# EAGLE board Resistor_Resistor (EAGLE 8.3.0), part 10 of 32
## Placement (x,y rotation side) (continued)
R11747  10K  [0201]  96.06,90.27 0 top
R11748  10K  [0201]  96.06,90.88 0 top
R11749  10K  [0201]  96.06,91.49 0 top
R11750  10K  [0201]  96.06,92.1 0 top
R11751  10K  [0201]  96.06,92.71 0 top
R11752  10K  [0201]  96.06,93.32 0 top
R11753  10K  [0201]  96.06,93.93 0 top
R11754  10K  [0201]  96.06,94.54 0 top
R11755  10K  [0201]  96.06,95.15 0 top
R11756  10K  [0201]  96.06,95.76 0 top
R11757  10K  [0201]  96.06,96.37 0 top
R11758  10K  [0201]  96.06,96.98 0 top
R11759  10K  [0201]  96.06,97.59 0 top
R11760  10K  [0201]  96.06,98.2 0 top
R11761  10K  [0201]  96.06,98.81 0 top
R11762  10K  [0201]  96.06,99.42 0 top
R11763  10K  [0201]  96.06,100.03 0 top
R11764  10K  [0201]  96.06,100.63 0 top
R11765  10K  [0201]  96.06,101.24 0 top
R11766  10K  [0201]  96.06,101.85 0 top
R11767  10K  [0201]  96.06,102.46 0 top
R11768  10K  [0201]  96.06,103.07 0 top
R11769  10K  [0201]  96.06,103.68 0 top
R11770  10K  [0201]  96.06,104.29 0 top
R11771  10K  [0201]  96.06,104.9 0 top
R11772  10K  [0201]  96.06,105.51 0 top
R11773  10K  [0201]  96.06,106.12 0 top
R11774  10K  [0201]  96.06,106.73 0 top
R11775  10K  [0201]  96.06,107.34 0 top
R11776  10K  [0201]  96.06,107.95 0 top
R11777  10K  [0201]  96.06,108.56 0 top
R11778  10K  [0201]  96.06,109.17 0 top
R11779  10K  [0201]  96.06,109.78 0 top
R11780  10K  [0201]  96.06,110.39 0 top
R11781  10K  [0201]  96.06,111 0 top
R11782  10K  [0201]  96.06,111.61 0 top
R11783  10K  [0201]  96.06,112.22 0 top
R11784  10K  [0201]  96.06,112.83 0 top
R11785  10K  [0201]  96.06,113.44 0 top
R11786  10K  [0201]  96.06,114.05 0 top
R11787  10K  [0201]  96.06,114.66 0 top
R11788  10K  [0201]  96.06,115.27 0 top
R11789  10K  [0201]  96.06,115.87 0 top
R11790  10K  [0201]  96.06,116.48 0 top
R11791  10K  [0201]  96.06,117.09 0 top
R11792  10K  [0201]  96.06,117.7 0 top
R11793  10K  [0201]  96.06,118.31 0 top
R11794  10K  [0201]  96.06,118.92 0 top
R11795  10K  [0201]  96.06,119.53 0 top
R11796  10K  [0201]  96.06,120.14 0 top
R11797  10K  [0201]  96.06,120.75 0 top
R11798  10K  [0201]  96.06,121.36 0 top
R11799  10K  [0201]  96.06,121.97 0 top
R11800  10K  [0201]  96.06,122.58 0 top
R11801  10K  [0201]  97.28,1.27 0 top
R11802  10K  [0201]  97.28,1.88 0 top
R11803  10K  [0201]  97.28,2.49 0 top
R11804  10K  [0201]  97.28,3.1 0 top
R11805  10K  [0201]  97.28,3.71 0 top
R11806  10K  [0201]  97.28,4.32 0 top
R11807  10K  [0201]  97.28,4.93 0 top
R11808  10K  [0201]  97.28,5.54 0 top
R11809  10K  [0201]  97.28,6.15 0 top
R11810  10K  [0201]  97.28,6.76 0 top
R11811  10K  [0201]  97.28,7.37 0 top
R11812  10K  [0201]  97.28,7.98 0 top
R11813  10K  [0201]  97.28,8.59 0 top
R11814  10K  [0201]  97.28,9.19 0 top
R11815  10K  [0201]  97.28,9.8 0 top
R11816  10K  [0201]  97.28,10.41 0 top
R11817  10K  [0201]  97.28,11.02 0 top
R11818  10K  [0201]  97.28,11.63 0 top
R11819  10K  [0201]  97.28,12.24 0 top
R11820  10K  [0201]  97.28,12.85 0 top
R11821  10K  [0201]  97.28,13.46 0 top
R11822  10K  [0201]  97.28,14.07 0 top
R11823  10K  [0201]  97.28,14.68 0 top
R11824  10K  [0201]  97.28,15.29 0 top
R11825  10K  [0201]  97.28,15.9 0 top
R11826  10K  [0201]  97.28,16.51 0 top
R11827  10K  [0201]  97.28,17.12 0 top
R11828  10K  [0201]  97.28,17.73 0 top
R11829  10K  [0201]  97.28,18.34 0 top
R11830  10K  [0201]  97.28,18.95 0 top
R11831  10K  [0201]  97.28,19.56 0 top
R11832  10K  [0201]  97.28,20.17 0 top
R11833  10K  [0201]  97.28,20.78 0 top
R11834  10K  [0201]  97.28,21.39 0 top
R11835  10K  [0201]  97.28,22 0 top
R11836  10K  [0201]  97.28,22.61 0 top
R11837  10K  [0201]  97.28,23.22 0 top
R11838  10K  [0201]  97.28,23.83 0 top
R11839  10K  [0201]  97.28,24.43 0 top
R11840  10K  [0201]  97.28,25.04 0 top
R11841  10K  [0201]  97.28,25.65 0 top
R11842  10K  [0201]  97.28,26.26 0 top
R11843  10K  [0201]  97.28,26.87 0 top
R11844  10K  [0201]  97.28,27.48 0 top
R11845  10K  [0201]  97.28,28.09 0 top
R11846  10K  [0201]  97.28,28.7 0 top
R11847  10K  [0201]  97.28,29.31 0 top
R11848  10K  [0201]  97.28,29.92 0 top
R11849  10K  [0201]  97.28,30.53 0 top
R11850  10K  [0201]  97.28,31.14 0 top
R11851  10K  [0201]  97.28,31.75 0 top
R11852  10K  [0201]  97.28,32.36 0 top
R11853  10K  [0201]  97.28,32.97 0 top
R11854  10K  [0201]  97.28,33.58 0 top
R11855  10K  [0201]  97.28,34.19 0 top
R11856  10K  [0201]  97.28,34.8 0 top
R11857  10K  [0201]  97.28,35.41 0 top
R11858  10K  [0201]  97.28,36.02 0 top
R11859  10K  [0201]  97.28,36.63 0 top
R11860  10K  [0201]  97.28,37.24 0 top
R11861  10K  [0201]  97.28,37.85 0 top
R11862  10K  [0201]  97.28,38.46 0 top
R11863  10K  [0201]  97.28,39.07 0 top
R11864  10K  [0201]  97.28,39.67 0 top
R11865  10K  [0201]  97.28,40.28 0 top
R11866  10K  [0201]  97.28,40.89 0 top
R11867  10K  [0201]  97.28,41.5 0 top
R11868  10K  [0201]  97.28,42.11 0 top
R11869  10K  [0201]  97.28,42.72 0 top
R11870  10K  [0201]  97.28,43.33 0 top
R11871  10K  [0201]  97.28,43.94 0 top
R11872  10K  [0201]  97.28,44.55 0 top
R11873  10K  [0201]  97.28,45.16 0 top
R11874  10K  [0201]  97.28,45.77 0 top
R11875  10K  [0201]  97.28,46.38 0 top
R11876  10K  [0201]  97.28,46.99 0 top
R11877  10K  [0201]  97.28,47.6 0 top
R11878  10K  [0201]  97.28,48.21 0 top
R11879  10K  [0201]  97.28,48.82 0 top
R11880  10K  [0201]  97.28,49.43 0 top
R11881  10K  [0201]  97.28,50.04 0 top
R11882  10K  [0201]  97.28,50.65 0 top
R11883  10K  [0201]  97.28,51.26 0 top
R11884  10K  [0201]  97.28,51.87 0 top
R11885  10K  [0201]  97.28,52.48 0 top
R11886  10K  [0201]  97.28,53.09 0 top
R11887  10K  [0201]  97.28,53.7 0 top
R11888  10K  [0201]  97.28,54.31 0 top
R11889  10K  [0201]  97.28,54.91 0 top
R11890  10K  [0201]  97.28,55.52 0 top
R11891  10K  [0201]  97.28,56.13 0 top
R11892  10K  [0201]  97.28,56.74 0 top
R11893  10K  [0201]  97.28,57.35 0 top
R11894  10K  [0201]  97.28,57.96 0 top
R11895  10K  [0201]  97.28,58.57 0 top
R11896  10K  [0201]  97.28,59.18 0 top
R11897  10K  [0201]  97.28,59.79 0 top
R11898  10K  [0201]  97.28,60.4 0 top
R11899  10K  [0201]  97.28,61.01 0 top
R11900  10K  [0201]  97.28,61.62 0 top
R11901  10K  [0201]  97.28,62.23 0 top
R11902  10K  [0201]  97.28,62.84 0 top
R11903  10K  [0201]  97.28,63.45 0 top
R11904  10K  [0201]  97.28,64.06 0 top
R11905  10K  [0201]  97.28,64.67 0 top
R11906  10K  [0201]  97.28,65.28 0 top
R11907  10K  [0201]  97.28,65.89 0 top
R11908  10K  [0201]  97.28,66.5 0 top
R11909  10K  [0201]  97.28,67.11 0 top
R11910  10K  [0201]  97.28,67.72 0 top
R11911  10K  [0201]  97.28,68.33 0 top
R11912  10K  [0201]  97.28,68.94 0 top
R11913  10K  [0201]  97.28,69.55 0 top
R11914  10K  [0201]  97.28,70.15 0 top
R11915  10K  [0201]  97.28,70.76 0 top
R11916  10K  [0201]  97.28,71.37 0 top
R11917  10K  [0201]  97.28,71.98 0 top
R11918  10K  [0201]  97.28,72.59 0 top
R11919  10K  [0201]  97.28,73.2 0 top
R11920  10K  [0201]  97.28,73.81 0 top
R11921  10K  [0201]  97.28,74.42 0 top
R11922  10K  [0201]  97.28,75.03 0 top
R11923  10K  [0201]  97.28,75.64 0 top
R11924  10K  [0201]  97.28,76.25 0 top
R11925  10K  [0201]  97.28,76.86 0 top
R11926  10K  [0201]  97.28,77.47 0 top
R11927  10K  [0201]  97.28,78.08 0 top
R11928  10K  [0201]  97.28,78.69 0 top
R11929  10K  [0201]  97.28,79.3 0 top
R11930  10K  [0201]  97.28,79.91 0 top
R11931  10K  [0201]  97.28,80.52 0 top
R11932  10K  [0201]  97.28,81.13 0 top
R11933  10K  [0201]  97.28,81.74 0 top
R11934  10K  [0201]  97.28,82.35 0 top
R11935  10K  [0201]  97.28,82.96 0 top
R11936  10K  [0201]  97.28,83.57 0 top
R11937  10K  [0201]  97.28,84.18 0 top
R11938  10K  [0201]  97.28,84.79 0 top
R11939  10K  [0201]  97.28,85.39 0 top
R11940  10K  [0201]  97.28,86 0 top
R11941  10K  [0201]  97.28,86.61 0 top
R11942  10K  [0201]  97.28,87.22 0 top
R11943  10K  [0201]  97.28,87.83 0 top
R11944  10K  [0201]  97.28,88.44 0 top
R11945  10K  [0201]  97.28,89.05 0 top
R11946  10K  [0201]  97.28,89.66 0 top
R11947  10K  [0201]  97.28,90.27 0 top
R11948  10K  [0201]  97.28,90.88 0 top
R11949  10K  [0201]  97.28,91.49 0 top
R11950  10K  [0201]  97.28,92.1 0 top
R11951  10K  [0201]  97.28,92.71 0 top
R11952  10K  [0201]  97.28,93.32 0 top
R11953  10K  [0201]  97.28,93.93 0 top
R11954  10K  [0201]  97.28,94.54 0 top
R11955  10K  [0201]  97.28,95.15 0 top
R11956  10K  [0201]  97.28,95.76 0 top
R11957  10K  [0201]  97.28,96.37 0 top
R11958  10K  [0201]  97.28,96.98 0 top
R11959  10K  [0201]  97.28,97.59 0 top
R11960  10K  [0201]  97.28,98.2 0 top
R11961  10K  [0201]  97.28,98.81 0 top
R11962  10K  [0201]  97.28,99.42 0 top
R11963  10K  [0201]  97.28,100.03 0 top
R11964  10K  [0201]  97.28,100.63 0 top
R11965  10K  [0201]  97.28,101.24 0 top
R11966  10K  [0201]  97.28,101.85 0 top
R11967  10K  [0201]  97.28,102.46 0 top
R11968  10K  [0201]  97.28,103.07 0 top
R11969  10K  [0201]  97.28,103.68 0 top
R11970  10K  [0201]  97.28,104.29 0 top
R11971  10K  [0201]  97.28,104.9 0 top
R11972  10K  [0201]  97.28,105.51 0 top
R11973  10K  [0201]  97.28,106.12 0 top
R11974  10K  [0201]  97.28,106.73 0 top
R11975  10K  [0201]  97.28,107.34 0 top
R11976  10K  [0201]  97.28,107.95 0 top
R11977  10K  [0201]  97.28,108.56 0 top
R11978  10K  [0201]  97.28,109.17 0 top
R11979  10K  [0201]  97.28,109.78 0 top
R11980  10K  [0201]  97.28,110.39 0 top
R11981  10K  [0201]  97.28,111 0 top
R11982  10K  [0201]  97.28,111.61 0 top
R11983  10K  [0201]  97.28,112.22 0 top
R11984  10K  [0201]  97.28,112.83 0 top
R11985  10K  [0201]  97.28,113.44 0 top
R11986  10K  [0201]  97.28,114.05 0 top
R11987  10K  [0201]  97.28,114.66 0 top
R11988  10K  [0201]  97.28,115.27 0 top
R11989  10K  [0201]  97.28,115.87 0 top
R11990  10K  [0201]  97.28,116.48 0 top
R11991  10K  [0201]  97.28,117.09 0 top
R11992  10K  [0201]  97.28,117.7 0 top
R11993  10K  [0201]  97.28,118.31 0 top
R11994  10K  [0201]  97.28,118.92 0 top
R11995  10K  [0201]  97.28,119.53 0 top
R11996  10K  [0201]  97.28,120.14 0 top
R11997  10K  [0201]  97.28,120.75 0 top
R11998  10K  [0201]  97.28,121.36 0 top
R11999  10K  [0201]  97.28,121.97 0 top
R12000  10K  [0201]  97.28,122.58 0 top
R12001  10K  [0201]  98.5,1.27 0 top
R12002  10K  [0201]  98.5,1.88 0 top
R12003  10K  [0201]  98.5,2.49 0 top
R12004  10K  [0201]  98.5,3.1 0 top
R12005  10K  [0201]  98.5,3.71 0 top
R12006  10K  [0201]  98.5,4.32 0 top
R12007  10K  [0201]  98.5,4.93 0 top
R12008  10K  [0201]  98.5,5.54 0 top
R12009  10K  [0201]  98.5,6.15 0 top
R12010  10K  [0201]  98.5,6.76 0 top
R12011  10K  [0201]  98.5,7.37 0 top
R12012  10K  [0201]  98.5,7.98 0 top
R12013  10K  [0201]  98.5,8.59 0 top
R12014  10K  [0201]  98.5,9.19 0 top
R12015  10K  [0201]  98.5,9.8 0 top
R12016  10K  [0201]  98.5,10.41 0 top
R12017  10K  [0201]  98.5,11.02 0 top
R12018  10K  [0201]  98.5,11.63 0 top
R12019  10K  [0201]  98.5,12.24 0 top
R12020  10K  [0201]  98.5,12.85 0 top
R12021  10K  [0201]  98.5,13.46 0 top
R12022  10K  [0201]  98.5,14.07 0 top
R12023  10K  [0201]  98.5,14.68 0 top
R12024  10K  [0201]  98.5,15.29 0 top
R12025  10K  [0201]  98.5,15.9 0 top
R12026  10K  [0201]  98.5,16.51 0 top
R12027  10K  [0201]  98.5,17.12 0 top
R12028  10K  [0201]  98.5,17.73 0 top
R12029  10K  [0201]  98.5,18.34 0 top
R12030  10K  [0201]  98.5,18.95 0 top
R12031  10K  [0201]  98.5,19.56 0 top
R12032  10K  [0201]  98.5,20.17 0 top
R12033  10K  [0201]  98.5,20.78 0 top
R12034  10K  [0201]  98.5,21.39 0 top
R12035  10K  [0201]  98.5,22 0 top
R12036  10K  [0201]  98.5,22.61 0 top
R12037  10K  [0201]  98.5,23.22 0 top
R12038  10K  [0201]  98.5,23.83 0 top
R12039  10K  [0201]  98.5,24.43 0 top
R12040  10K  [0201]  98.5,25.04 0 top
R12041  10K  [0201]  98.5,25.65 0 top
R12042  10K  [0201]  98.5,26.26 0 top
R12043  10K  [0201]  98.5,26.87 0 top
R12044  10K  [0201]  98.5,27.48 0 top
R12045  10K  [0201]  98.5,28.09 0 top
R12046  10K  [0201]  98.5,28.7 0 top
R12047  10K  [0201]  98.5,29.31 0 top
R12048  10K  [0201]  98.5,29.92 0 top
R12049  10K  [0201]  98.5,30.53 0 top
R12050  10K  [0201]  98.5,31.14 0 top
R12051  10K  [0201]  98.5,31.75 0 top
R12052  10K  [0201]  98.5,32.36 0 top
R12053  10K  [0201]  98.5,32.97 0 top
R12054  10K  [0201]  98.5,33.58 0 top
R12055  10K  [0201]  98.5,34.19 0 top
R12056  10K  [0201]  98.5,34.8 0 top
R12057  10K  [0201]  98.5,35.41 0 top
R12058  10K  [0201]  98.5,36.02 0 top
R12059  10K  [0201]  98.5,36.63 0 top
R12060  10K  [0201]  98.5,37.24 0 top
R12061  10K  [0201]  98.5,37.85 0 top
R12062  10K  [0201]  98.5,38.46 0 top
R12063  10K  [0201]  98.5,39.07 0 top
R12064  10K  [0201]  98.5,39.67 0 top
R12065  10K  [0201]  98.5,40.28 0 top
R12066  10K  [0201]  98.5,40.89 0 top
R12067  10K  [0201]  98.5,41.5 0 top
R12068  10K  [0201]  98.5,42.11 0 top
R12069  10K  [0201]  98.5,42.72 0 top
R12070  10K  [0201]  98.5,43.33 0 top
R12071  10K  [0201]  98.5,43.94 0 top
R12072  10K  [0201]  98.5,44.55 0 top
R12073  10K  [0201]  98.5,45.16 0 top
R12074  10K  [0201]  98.5,45.77 0 top
R12075  10K  [0201]  98.5,46.38 0 top
R12076  10K  [0201]  98.5,46.99 0 top
R12077  10K  [0201]  98.5,47.6 0 top
R12078  10K  [0201]  98.5,48.21 0 top
R12079  10K  [0201]  98.5,48.82 0 top
R12080  10K  [0201]  98.5,49.43 0 top
R12081  10K  [0201]  98.5,50.04 0 top
R12082  10K  [0201]  98.5,50.65 0 top
R12083  10K  [0201]  98.5,51.26 0 top
R12084  10K  [0201]  98.5,51.87 0 top
R12085  10K  [0201]  98.5,52.48 0 top
R12086  10K  [0201]  98.5,53.09 0 top
R12087  10K  [0201]  98.5,53.7 0 top
R12088  10K  [0201]  98.5,54.31 0 top
R12089  10K  [0201]  98.5,54.91 0 top
R12090  10K  [0201]  98.5,55.52 0 top
R12091  10K  [0201]  98.5,56.13 0 top
R12092  10K  [0201]  98.5,56.74 0 top
R12093  10K  [0201]  98.5,57.35 0 top
R12094  10K  [0201]  98.5,57.96 0 top
R12095  10K  [0201]  98.5,58.57 0 top
R12096  10K  [0201]  98.5,59.18 0 top
R12097  10K  [0201]  98.5,59.79 0 top
R12098  10K  [0201]  98.5,60.4 0 top
R12099  10K  [0201]  98.5,61.01 0 top
R12100  10K  [0201]  98.5,61.62 0 top
R12101  10K  [0201]  98.5,62.23 0 top
R12102  10K  [0201]  98.5,62.84 0 top
R12103  10K  [0201]  98.5,63.45 0 top
R12104  10K  [0201]  98.5,64.06 0 top
R12105  10K  [0201]  98.5,64.67 0 top
R12106  10K  [0201]  98.5,65.28 0 top
R12107  10K  [0201]  98.5,65.89 0 top
R12108  10K  [0201]  98.5,66.5 0 top
R12109  10K  [0201]  98.5,67.11 0 top
R12110  10K  [0201]  98.5,67.72 0 top
R12111  10K  [0201]  98.5,68.33 0 top
R12112  10K  [0201]  98.5,68.94 0 top
R12113  10K  [0201]  98.5,69.55 0 top
R12114  10K  [0201]  98.5,70.15 0 top
R12115  10K  [0201]  98.5,70.76 0 top
R12116  10K  [0201]  98.5,71.37 0 top
R12117  10K  [0201]  98.5,71.98 0 top
R12118  10K  [0201]  98.5,72.59 0 top
R12119  10K  [0201]  98.5,73.2 0 top
R12120  10K  [0201]  98.5,73.81 0 top
R12121  10K  [0201]  98.5,74.42 0 top
R12122  10K  [0201]  98.5,75.03 0 top
R12123  10K  [0201]  98.5,75.64 0 top
R12124  10K  [0201]  98.5,76.25 0 top
R12125  10K  [0201]  98.5,76.86 0 top
R12126  10K  [0201]  98.5,77.47 0 top
R12127  10K  [0201]  98.5,78.08 0 top
R12128  10K  [0201]  98.5,78.69 0 top
R12129  10K  [0201]  98.5,79.3 0 top
R12130  10K  [0201]  98.5,79.91 0 top
R12131  10K  [0201]  98.5,80.52 0 top
R12132  10K  [0201]  98.5,81.13 0 top
R12133  10K  [0201]  98.5,81.74 0 top
R12134  10K  [0201]  98.5,82.35 0 top
R12135  10K  [0201]  98.5,82.96 0 top
R12136  10K  [0201]  98.5,83.57 0 top
R12137  10K  [0201]  98.5,84.18 0 top
R12138  10K  [0201]  98.5,84.79 0 top
R12139  10K  [0201]  98.5,85.39 0 top
R12140  10K  [0201]  98.5,86 0 top
R12141  10K  [0201]  98.5,86.61 0 top
R12142  10K  [0201]  98.5,87.22 0 top
R12143  10K  [0201]  98.5,87.83 0 top
R12144  10K  [0201]  98.5,88.44 0 top
R12145  10K  [0201]  98.5,89.05 0 top
R12146  10K  [0201]  98.5,89.66 0 top
R12147  10K  [0201]  98.5,90.27 0 top
R12148  10K  [0201]  98.5,90.88 0 top
R12149  10K  [0201]  98.5,91.49 0 top
R12150  10K  [0201]  98.5,92.1 0 top
R12151  10K  [0201]  98.5,92.71 0 top
R12152  10K  [0201]  98.5,93.32 0 top
R12153  10K  [0201]  98.5,93.93 0 top
R12154  10K  [0201]  98.5,94.54 0 top
R12155  10K  [0201]  98.5,95.15 0 top
R12156  10K  [0201]  98.5,95.76 0 top
R12157  10K  [0201]  98.5,96.37 0 top
R12158  10K  [0201]  98.5,96.98 0 top
R12159  10K  [0201]  98.5,97.59 0 top
R12160  10K  [0201]  98.5,98.2 0 top
R12161  10K  [0201]  98.5,98.81 0 top
R12162  10K  [0201]  98.5,99.42 0 top
R12163  10K  [0201]  98.5,100.03 0 top
R12164  10K  [0201]  98.5,100.63 0 top
R12165  10K  [0201]  98.5,101.24 0 top
R12166  10K  [0201]  98.5,101.85 0 top
R12167  10K  [0201]  98.5,102.46 0 top
R12168  10K  [0201]  98.5,103.07 0 top
R12169  10K  [0201]  98.5,103.68 0 top
R12170  10K  [0201]  98.5,104.29 0 top
R12171  10K  [0201]  98.5,104.9 0 top
R12172  10K  [0201]  98.5,105.51 0 top
R12173  10K  [0201]  98.5,106.12 0 top
R12174  10K  [0201]  98.5,106.73 0 top
R12175  10K  [0201]  98.5,107.34 0 top
R12176  10K  [0201]  98.5,107.95 0 top
R12177  10K  [0201]  98.5,108.56 0 top
R12178  10K  [0201]  98.5,109.17 0 top
R12179  10K  [0201]  98.5,109.78 0 top
R12180  10K  [0201]  98.5,110.39 0 top
R12181  10K  [0201]  98.5,111 0 top
R12182  10K  [0201]  98.5,111.61 0 top
R12183  10K  [0201]  98.5,112.22 0 top
R12184  10K  [0201]  98.5,112.83 0 top
R12185  10K  [0201]  98.5,113.44 0 top
R12186  10K  [0201]  98.5,114.05 0 top
R12187  10K  [0201]  98.5,114.66 0 top
R12188  10K  [0201]  98.5,115.27 0 top
R12189  10K  [0201]  98.5,115.87 0 top
R12190  10K  [0201]  98.5,116.48 0 top
R12191  10K  [0201]  98.5,117.09 0 top
R12192  10K  [0201]  98.5,117.7 0 top
R12193  10K  [0201]  98.5,118.31 0 top
R12194  10K  [0201]  98.5,118.92 0 top
R12195  10K  [0201]  98.5,119.53 0 top
R12196  10K  [0201]  98.5,120.14 0 top
R12197  10K  [0201]  98.5,120.75 0 top
R12198  10K  [0201]  98.5,121.36 0 top
R12199  10K  [0201]  98.5,121.97 0 top
R12200  10K  [0201]  98.5,122.58 0 top
R12201  10K  [0201]  99.72,1.27 0 top
R12202  10K  [0201]  99.72,1.88 0 top
R12203  10K  [0201]  99.72,2.49 0 top
R12204  10K  [0201]  99.72,3.1 0 top
R12205  10K  [0201]  99.72,3.71 0 top
R12206  10K  [0201]  99.72,4.32 0 top
R12207  10K  [0201]  99.72,4.93 0 top
R12208  10K  [0201]  99.72,5.54 0 top
R12209  10K  [0201]  99.72,6.15 0 top
R12210  10K  [0201]  99.72,6.76 0 top
R12211  10K  [0201]  99.72,7.37 0 top
R12212  10K  [0201]  99.72,7.98 0 top
R12213  10K  [0201]  99.72,8.59 0 top
R12214  10K  [0201]  99.72,9.19 0 top
R12215  10K  [0201]  99.72,9.8 0 top
R12216  10K  [0201]  99.72,10.41 0 top
R12217  10K  [0201]  99.72,11.02 0 top
R12218  10K  [0201]  99.72,11.63 0 top
R12219  10K  [0201]  99.72,12.24 0 top
R12220  10K  [0201]  99.72,12.85 0 top
R12221  10K  [0201]  99.72,13.46 0 top
R12222  10K  [0201]  99.72,14.07 0 top
R12223  10K  [0201]  99.72,14.68 0 top
R12224  10K  [0201]  99.72,15.29 0 top
R12225  10K  [0201]  99.72,15.9 0 top
R12226  10K  [0201]  99.72,16.51 0 top
R12227  10K  [0201]  99.72,17.12 0 top
R12228  10K  [0201]  99.72,17.73 0 top
R12229  10K  [0201]  99.72,18.34 0 top
R12230  10K  [0201]  99.72,18.95 0 top
R12231  10K  [0201]  99.72,19.56 0 top
R12232  10K  [0201]  99.72,20.17 0 top
R12233  10K  [0201]  99.72,20.78 0 top
R12234  10K  [0201]  99.72,21.39 0 top
R12235  10K  [0201]  99.72,22 0 top
R12236  10K  [0201]  99.72,22.61 0 top
R12237  10K  [0201]  99.72,23.22 0 top
R12238  10K  [0201]  99.72,23.83 0 top
R12239  10K  [0201]  99.72,24.43 0 top
R12240  10K  [0201]  99.72,25.04 0 top
R12241  10K  [0201]  99.72,25.65 0 top
R12242  10K  [0201]  99.72,26.26 0 top
R12243  10K  [0201]  99.72,26.87 0 top
R12244  10K  [0201]  99.72,27.48 0 top
R12245  10K  [0201]  99.72,28.09 0 top
R12246  10K  [0201]  99.72,28.7 0 top
R12247  10K  [0201]  99.72,29.31 0 top
R12248  10K  [0201]  99.72,29.92 0 top
R12249  10K  [0201]  99.72,30.53 0 top
R12250  10K  [0201]  99.72,31.14 0 top
R12251  10K  [0201]  99.72,31.75 0 top
R12252  10K  [0201]  99.72,32.36 0 top
R12253  10K  [0201]  99.72,32.97 0 top
R12254  10K  [0201]  99.72,33.58 0 top
R12255  10K  [0201]  99.72,34.19 0 top
R12256  10K  [0201]  99.72,34.8 0 top
R12257  10K  [0201]  99.72,35.41 0 top
R12258  10K  [0201]  99.72,36.02 0 top
R12259  10K  [0201]  99.72,36.63 0 top
R12260  10K  [0201]  99.72,37.24 0 top
R12261  10K  [0201]  99.72,37.85 0 top
R12262  10K  [0201]  99.72,38.46 0 top
R12263  10K  [0201]  99.72,39.07 0 top
R12264  10K  [0201]  99.72,39.67 0 top
R12265  10K  [0201]  99.72,40.28 0 top
R12266  10K  [0201]  99.72,40.89 0 top
R12267  10K  [0201]  99.72,41.5 0 top
R12268  10K  [0201]  99.72,42.11 0 top
R12269  10K  [0201]  99.72,42.72 0 top
R12270  10K  [0201]  99.72,43.33 0 top
R12271  10K  [0201]  99.72,43.94 0 top
R12272  10K  [0201]  99.72,44.55 0 top
R12273  10K  [0201]  99.72,45.16 0 top
R12274  10K  [0201]  99.72,45.77 0 top
R12275  10K  [0201]  99.72,46.38 0 top
R12276  10K  [0201]  99.72,46.99 0 top
R12277  10K  [0201]  99.72,47.6 0 top
R12278  10K  [0201]  99.72,48.21 0 top
R12279  10K  [0201]  99.72,48.82 0 top
R12280  10K  [0201]  99.72,49.43 0 top
R12281  10K  [0201]  99.72,50.04 0 top
R12282  10K  [0201]  99.72,50.65 0 top
R12283  10K  [0201]  99.72,51.26 0 top
R12284  10K  [0201]  99.72,51.87 0 top
R12285  10K  [0201]  99.72,52.48 0 top
R12286  10K  [0201]  99.72,53.09 0 top
R12287  10K  [0201]  99.72,53.7 0 top
R12288  10K  [0201]  99.72,54.31 0 top
R12289  10K  [0201]  99.72,54.91 0 top
R12290  10K  [0201]  99.72,55.52 0 top
R12291  10K  [0201]  99.72,56.13 0 top
R12292  10K  [0201]  99.72,56.74 0 top
R12293  10K  [0201]  99.72,57.35 0 top
R12294  10K  [0201]  99.72,57.96 0 top
R12295  10K  [0201]  99.72,58.57 0 top
R12296  10K  [0201]  99.72,59.18 0 top
R12297  10K  [0201]  99.72,59.79 0 top
R12298  10K  [0201]  99.72,60.4 0 top
R12299  10K  [0201]  99.72,61.01 0 top
R12300  10K  [0201]  99.72,61.62 0 top
R12301  10K  [0201]  99.72,62.23 0 top
R12302  10K  [0201]  99.72,62.84 0 top
R12303  10K  [0201]  99.72,63.45 0 top
R12304  10K  [0201]  99.72,64.06 0 top
R12305  10K  [0201]  99.72,64.67 0 top
R12306  10K  [0201]  99.72,65.28 0 top
R12307  10K  [0201]  99.72,65.89 0 top
R12308  10K  [0201]  99.72,66.5 0 top
R12309  10K  [0201]  99.72,67.11 0 top
R12310  10K  [0201]  99.72,67.72 0 top
R12311  10K  [0201]  99.72,68.33 0 top
R12312  10K  [0201]  99.72,68.94 0 top
R12313  10K  [0201]  99.72,69.55 0 top
R12314  10K  [0201]  99.72,70.15 0 top
R12315  10K  [0201]  99.72,70.76 0 top
R12316  10K  [0201]  99.72,71.37 0 top
R12317  10K  [0201]  99.72,71.98 0 top
R12318  10K  [0201]  99.72,72.59 0 top
R12319  10K  [0201]  99.72,73.2 0 top
R12320  10K  [0201]  99.72,73.81 0 top
R12321  10K  [0201]  99.72,74.42 0 top
R12322  10K  [0201]  99.72,75.03 0 top
R12323  10K  [0201]  99.72,75.64 0 top
R12324  10K  [0201]  99.72,76.25 0 top
R12325  10K  [0201]  99.72,76.86 0 top
R12326  10K  [0201]  99.72,77.47 0 top
R12327  10K  [0201]  99.72,78.08 0 top
R12328  10K  [0201]  99.72,78.69 0 top
R12329  10K  [0201]  99.72,79.3 0 top
R12330  10K  [0201]  99.72,79.91 0 top
R12331  10K  [0201]  99.72,80.52 0 top
R12332  10K  [0201]  99.72,81.13 0 top
R12333  10K  [0201]  99.72,81.74 0 top
R12334  10K  [0201]  99.72,82.35 0 top
R12335  10K  [0201]  99.72,82.96 0 top
R12336  10K  [0201]  99.72,83.57 0 top
R12337  10K  [0201]  99.72,84.18 0 top
R12338  10K  [0201]  99.72,84.79 0 top
R12339  10K  [0201]  99.72,85.39 0 top
R12340  10K  [0201]  99.72,86 0 top
R12341  10K  [0201]  99.72,86.61 0 top
R12342  10K  [0201]  99.72,87.22 0 top
R12343  10K  [0201]  99.72,87.83 0 top
R12344  10K  [0201]  99.72,88.44 0 top
R12345  10K  [0201]  99.72,89.05 0 top
R12346  10K  [0201]  99.72,89.66 0 top
R12347  10K  [0201]  99.72,90.27 0 top
R12348  10K  [0201]  99.72,90.88 0 top
R12349  10K  [0201]  99.72,91.49 0 top
R12350  10K  [0201]  99.72,92.1 0 top
R12351  10K  [0201]  99.72,92.71 0 top
R12352  10K  [0201]  99.72,93.32 0 top
R12353  10K  [0201]  99.72,93.93 0 top
R12354  10K  [0201]  99.72,94.54 0 top
R12355  10K  [0201]  99.72,95.15 0 top
R12356  10K  [0201]  99.72,95.76 0 top
R12357  10K  [0201]  99.72,96.37 0 top
R12358  10K  [0201]  99.72,96.98 0 top
R12359  10K  [0201]  99.72,97.59 0 top
R12360  10K  [0201]  99.72,98.2 0 top
R12361  10K  [0201]  99.72,98.81 0 top
R12362  10K  [0201]  99.72,99.42 0 top
R12363  10K  [0201]  99.72,100.03 0 top
R12364  10K  [0201]  99.72,100.63 0 top
R12365  10K  [0201]  99.72,101.24 0 top
R12366  10K  [0201]  99.72,101.85 0 top
R12367  10K  [0201]  99.72,102.46 0 top
R12368  10K  [0201]  99.72,103.07 0 top
R12369  10K  [0201]  99.72,103.68 0 top
R12370  10K  [0201]  99.72,104.29 0 top
R12371  10K  [0201]  99.72,104.9 0 top
R12372  10K  [0201]  99.72,105.51 0 top
R12373  10K  [0201]  99.72,106.12 0 top
R12374  10K  [0201]  99.72,106.73 0 top
R12375  10K  [0201]  99.72,107.34 0 top
R12376  10K  [0201]  99.72,107.95 0 top
R12377  10K  [0201]  99.72,108.56 0 top
R12378  10K  [0201]  99.72,109.17 0 top
R12379  10K  [0201]  99.72,109.78 0 top
R12380  10K  [0201]  99.72,110.39 0 top
R12381  10K  [0201]  99.72,111 0 top
R12382  10K  [0201]  99.72,111.61 0 top
R12383  10K  [0201]  99.72,112.22 0 top
R12384  10K  [0201]  99.72,112.83 0 top
R12385  10K  [0201]  99.72,113.44 0 top
R12386  10K  [0201]  99.72,114.05 0 top
R12387  10K  [0201]  99.72,114.66 0 top
R12388  10K  [0201]  99.72,115.27 0 top
R12389  10K  [0201]  99.72,115.87 0 top
R12390  10K  [0201]  99.72,116.48 0 top
R12391  10K  [0201]  99.72,117.09 0 top
R12392  10K  [0201]  99.72,117.7 0 top
R12393  10K  [0201]  99.72,118.31 0 top
R12394  10K  [0201]  99.72,118.92 0 top
R12395  10K  [0201]  99.72,119.53 0 top
R12396  10K  [0201]  99.72,120.14 0 top
R12397  10K  [0201]  99.72,120.75 0 top
R12398  10K  [0201]  99.72,121.36 0 top
R12399  10K  [0201]  99.72,121.97 0 top
R12400  10K  [0201]  99.72,122.58 0 top
R12401  10K  [0201]  100.94,1.27 0 top
R12402  10K  [0201]  100.94,1.88 0 top
R12403  10K  [0201]  100.94,2.49 0 top
R12404  10K  [0201]  100.94,3.1 0 top
R12405  10K  [0201]  100.94,3.71 0 top
R12406  10K  [0201]  100.94,4.32 0 top
R12407  10K  [0201]  100.94,4.93 0 top
R12408  10K  [0201]  100.94,5.54 0 top
R12409  10K  [0201]  100.94,6.15 0 top
R12410  10K  [0201]  100.94,6.76 0 top
R12411  10K  [0201]  100.94,7.37 0 top
R12412  10K  [0201]  100.94,7.98 0 top
R12413  10K  [0201]  100.94,8.59 0 top
R12414  10K  [0201]  100.94,9.19 0 top
R12415  10K  [0201]  100.94,9.8 0 top
R12416  10K  [0201]  100.94,10.41 0 top
R12417  10K  [0201]  100.94,11.02 0 top
R12418  10K  [0201]  100.94,11.63 0 top
R12419  10K  [0201]  100.94,12.24 0 top
R12420  10K  [0201]  100.94,12.85 0 top
R12421  10K  [0201]  100.94,13.46 0 top
R12422  10K  [0201]  100.94,14.07 0 top
R12423  10K  [0201]  100.94,14.68 0 top
R12424  10K  [0201]  100.94,15.29 0 top
R12425  10K  [0201]  100.94,15.9 0 top
R12426  10K  [0201]  100.94,16.51 0 top
R12427  10K  [0201]  100.94,17.12 0 top
R12428  10K  [0201]  100.94,17.73 0 top
R12429  10K  [0201]  100.94,18.34 0 top
R12430  10K  [0201]  100.94,18.95 0 top
R12431  10K  [0201]  100.94,19.56 0 top
R12432  10K  [0201]  100.94,20.17 0 top
R12433  10K  [0201]  100.94,20.78 0 top
R12434  10K  [0201]  100.94,21.39 0 top
R12435  10K  [0201]  100.94,22 0 top
R12436  10K  [0201]  100.94,22.61 0 top
R12437  10K  [0201]  100.94,23.22 0 top
R12438  10K  [0201]  100.94,23.83 0 top
R12439  10K  [0201]  100.94,24.43 0 top
R12440  10K  [0201]  100.94,25.04 0 top
R12441  10K  [0201]  100.94,25.65 0 top
R12442  10K  [0201]  100.94,26.26 0 top
R12443  10K  [0201]  100.94,26.87 0 top
R12444  10K  [0201]  100.94,27.48 0 top
R12445  10K  [0201]  100.94,28.09 0 top
R12446  10K  [0201]  100.94,28.7 0 top
R12447  10K  [0201]  100.94,29.31 0 top
R12448  10K  [0201]  100.94,29.92 0 top
R12449  10K  [0201]  100.94,30.53 0 top
R12450  10K  [0201]  100.94,31.14 0 top
R12451  10K  [0201]  100.94,31.75 0 top
R12452  10K  [0201]  100.94,32.36 0 top
R12453  10K  [0201]  100.94,32.97 0 top
R12454  10K  [0201]  100.94,33.58 0 top
R12455  10K  [0201]  100.94,34.19 0 top
R12456  10K  [0201]  100.94,34.8 0 top
R12457  10K  [0201]  100.94,35.41 0 top
R12458  10K  [0201]  100.94,36.02 0 top
R12459  10K  [0201]  100.94,36.63 0 top
R12460  10K  [0201]  100.94,37.24 0 top
R12461  10K  [0201]  100.94,37.85 0 top
R12462  10K  [0201]  100.94,38.46 0 top
R12463  10K  [0201]  100.94,39.07 0 top
R12464  10K  [0201]  100.94,39.67 0 top
R12465  10K  [0201]  100.94,40.28 0 top
R12466  10K  [0201]  100.94,40.89 0 top
R12467  10K  [0201]  100.94,41.5 0 top
R12468  10K  [0201]  100.94,42.11 0 top
R12469  10K  [0201]  100.94,42.72 0 top
R12470  10K  [0201]  100.94,43.33 0 top
R12471  10K  [0201]  100.94,43.94 0 top
R12472  10K  [0201]  100.94,44.55 0 top
R12473  10K  [0201]  100.94,45.16 0 top
R12474  10K  [0201]  100.94,45.77 0 top
R12475  10K  [0201]  100.94,46.38 0 top
R12476  10K  [0201]  100.94,46.99 0 top
R12477  10K  [0201]  100.94,47.6 0 top
R12478  10K  [0201]  100.94,48.21 0 top
R12479  10K  [0201]  100.94,48.82 0 top
R12480  10K  [0201]  100.94,49.43 0 top
R12481  10K  [0201]  100.94,50.04 0 top
R12482  10K  [0201]  100.94,50.65 0 top
R12483  10K  [0201]  100.94,51.26 0 top
R12484  10K  [0201]  100.94,51.87 0 top
R12485  10K  [0201]  100.94,52.48 0 top
R12486  10K  [0201]  100.94,53.09 0 top
R12487  10K  [0201]  100.94,53.7 0 top
R12488  10K  [0201]  100.94,54.31 0 top
R12489  10K  [0201]  100.94,54.91 0 top
R12490  10K  [0201]  100.94,55.52 0 top
R12491  10K  [0201]  100.94,56.13 0 top
R12492  10K  [0201]  100.94,56.74 0 top
R12493  10K  [0201]  100.94,57.35 0 top
R12494  10K  [0201]  100.94,57.96 0 top
R12495  10K  [0201]  100.94,58.57 0 top
R12496  10K  [0201]  100.94,59.18 0 top
R12497  10K  [0201]  100.94,59.79 0 top
R12498  10K  [0201]  100.94,60.4 0 top
R12499  10K  [0201]  100.94,61.01 0 top
R12500  10K  [0201]  100.94,61.62 0 top
R12501  10K  [0201]  100.94,62.23 0 top
R12502  10K  [0201]  100.94,62.84 0 top
R12503  10K  [0201]  100.94,63.45 0 top
R12504  10K  [0201]  100.94,64.06 0 top
R12505  10K  [0201]  100.94,64.67 0 top
R12506  10K  [0201]  100.94,65.28 0 top
R12507  10K  [0201]  100.94,65.89 0 top
R12508  10K  [0201]  100.94,66.5 0 top
R12509  10K  [0201]  100.94,67.11 0 top
R12510  10K  [0201]  100.94,67.72 0 top
R12511  10K  [0201]  100.94,68.33 0 top
R12512  10K  [0201]  100.94,68.94 0 top
R12513  10K  [0201]  100.94,69.55 0 top
R12514  10K  [0201]  100.94,70.15 0 top
R12515  10K  [0201]  100.94,70.76 0 top
R12516  10K  [0201]  100.94,71.37 0 top
R12517  10K  [0201]  100.94,71.98 0 top
R12518  10K  [0201]  100.94,72.59 0 top
R12519  10K  [0201]  100.94,73.2 0 top
R12520  10K  [0201]  100.94,73.81 0 top
R12521  10K  [0201]  100.94,74.42 0 top
R12522  10K  [0201]  100.94,75.03 0 top
R12523  10K  [0201]  100.94,75.64 0 top
R12524  10K  [0201]  100.94,76.25 0 top
R12525  10K  [0201]  100.94,76.86 0 top
R12526  10K  [0201]  100.94,77.47 0 top
R12527  10K  [0201]  100.94,78.08 0 top
R12528  10K  [0201]  100.94,78.69 0 top
R12529  10K  [0201]  100.94,79.3 0 top
R12530  10K  [0201]  100.94,79.91 0 top
R12531  10K  [0201]  100.94,80.52 0 top
R12532  10K  [0201]  100.94,81.13 0 top
R12533  10K  [0201]  100.94,81.74 0 top
R12534  10K  [0201]  100.94,82.35 0 top
R12535  10K  [0201]  100.94,82.96 0 top
R12536  10K  [0201]  100.94,83.57 0 top
R12537  10K  [0201]  100.94,84.18 0 top
R12538  10K  [0201]  100.94,84.79 0 top
R12539  10K  [0201]  100.94,85.39 0 top
R12540  10K  [0201]  100.94,86 0 top
R12541  10K  [0201]  100.94,86.61 0 top
R12542  10K  [0201]  100.94,87.22 0 top
R12543  10K  [0201]  100.94,87.83 0 top
R12544  10K  [0201]  100.94,88.44 0 top
R12545  10K  [0201]  100.94,89.05 0 top
R12546  10K  [0201]  100.94,89.66 0 top
R12547  10K  [0201]  100.94,90.27 0 top
R12548  10K  [0201]  100.94,90.88 0 top
R12549  10K  [0201]  100.94,91.49 0 top
R12550  10K  [0201]  100.94,92.1 0 top
R12551  10K  [0201]  100.94,92.71 0 top
R12552  10K  [0201]  100.94,93.32 0 top
R12553  10K  [0201]  100.94,93.93 0 top
R12554  10K  [0201]  100.94,94.54 0 top
R12555  10K  [0201]  100.94,95.15 0 top
R12556  10K  [0201]  100.94,95.76 0 top
R12557  10K  [0201]  100.94,96.37 0 top
R12558  10K  [0201]  100.94,96.98 0 top
R12559  10K  [0201]  100.94,97.59 0 top
R12560  10K  [0201]  100.94,98.2 0 top
R12561  10K  [0201]  100.94,98.81 0 top
R12562  10K  [0201]  100.94,99.42 0 top
R12563  10K  [0201]  100.94,100.03 0 top
R12564  10K  [0201]  100.94,100.63 0 top
R12565  10K  [0201]  100.94,101.24 0 top
R12566  10K  [0201]  100.94,101.85 0 top
R12567  10K  [0201]  100.94,102.46 0 top
R12568  10K  [0201]  100.94,103.07 0 top
R12569  10K  [0201]  100.94,103.68 0 top
R12570  10K  [0201]  100.94,104.29 0 top
R12571  10K  [0201]  100.94,104.9 0 top
R12572  10K  [0201]  100.94,105.51 0 top
R12573  10K  [0201]  100.94,106.12 0 top
R12574  10K  [0201]  100.94,106.73 0 top
R12575  10K  [0201]  100.94,107.34 0 top
R12576  10K  [0201]  100.94,107.95 0 top
R12577  10K  [0201]  100.94,108.56 0 top
R12578  10K  [0201]  100.94,109.17 0 top
R12579  10K  [0201]  100.94,109.78 0 top
R12580  10K  [0201]  100.94,110.39 0 top
R12581  10K  [0201]  100.94,111 0 top
R12582  10K  [0201]  100.94,111.61 0 top
R12583  10K  [0201]  100.94,112.22 0 top
R12584  10K  [0201]  100.94,112.83 0 top
R12585  10K  [0201]  100.94,113.44 0 top
R12586  10K  [0201]  100.94,114.05 0 top
R12587  10K  [0201]  100.94,114.66 0 top
R12588  10K  [0201]  100.94,115.27 0 top
R12589  10K  [0201]  100.94,115.87 0 top
R12590  10K  [0201]  100.94,116.48 0 top
R12591  10K  [0201]  100.94,117.09 0 top
R12592  10K  [0201]  100.94,117.7 0 top
R12593  10K  [0201]  100.94,118.31 0 top
R12594  10K  [0201]  100.94,118.92 0 top
R12595  10K  [0201]  100.94,119.53 0 top
R12596  10K  [0201]  100.94,120.14 0 top
R12597  10K  [0201]  100.94,120.75 0 top
R12598  10K  [0201]  100.94,121.36 0 top
R12599  10K  [0201]  100.94,121.97 0 top
R12600  10K  [0201]  100.94,122.58 0 top
R12601  10K  [0201]  102.16,1.27 0 top
R12602  10K  [0201]  102.16,1.88 0 top
R12603  10K  [0201]  102.16,2.49 0 top
R12604  10K  [0201]  102.16,3.1 0 top
R12605  10K  [0201]  102.16,3.71 0 top
R12606  10K  [0201]  102.16,4.32 0 top
R12607  10K  [0201]  102.16,4.93 0 top
R12608  10K  [0201]  102.16,5.54 0 top
R12609  10K  [0201]  102.16,6.15 0 top
R12610  10K  [0201]  102.16,6.76 0 top
R12611  10K  [0201]  102.16,7.37 0 top
R12612  10K  [0201]  102.16,7.98 0 top
R12613  10K  [0201]  102.16,8.59 0 top
R12614  10K  [0201]  102.16,9.19 0 top
R12615  10K  [0201]  102.16,9.8 0 top
R12616  10K  [0201]  102.16,10.41 0 top
R12617  10K  [0201]  102.16,11.02 0 top
R12618  10K  [0201]  102.16,11.63 0 top
R12619  10K  [0201]  102.16,12.24 0 top
R12620  10K  [0201]  102.16,12.85 0 top
R12621  10K  [0201]  102.16,13.46 0 top
R12622  10K  [0201]  102.16,14.07 0 top
R12623  10K  [0201]  102.16,14.68 0 top
R12624  10K  [0201]  102.16,15.29 0 top
R12625  10K  [0201]  102.16,15.9 0 top
R12626  10K  [0201]  102.16,16.51 0 top
R12627  10K  [0201]  102.16,17.12 0 top
R12628  10K  [0201]  102.16,17.73 0 top
R12629  10K  [0201]  102.16,18.34 0 top
R12630  10K  [0201]  102.16,18.95 0 top
R12631  10K  [0201]  102.16,19.56 0 top
R12632  10K  [0201]  102.16,20.17 0 top
R12633  10K  [0201]  102.16,20.78 0 top
R12634  10K  [0201]  102.16,21.39 0 top
R12635  10K  [0201]  102.16,22 0 top
R12636  10K  [0201]  102.16,22.61 0 top
R12637  10K  [0201]  102.16,23.22 0 top
R12638  10K  [0201]  102.16,23.83 0 top
R12639  10K  [0201]  102.16,24.43 0 top
R12640  10K  [0201]  102.16,25.04 0 top
R12641  10K  [0201]  102.16,25.65 0 top
R12642  10K  [0201]  102.16,26.26 0 top
R12643  10K  [0201]  102.16,26.87 0 top
R12644  10K  [0201]  102.16,27.48 0 top
R12645  10K  [0201]  102.16,28.09 0 top
R12646  10K  [0201]  102.16,28.7 0 top
R12647  10K  [0201]  102.16,29.31 0 top
R12648  10K  [0201]  102.16,29.92 0 top
R12649  10K  [0201]  102.16,30.53 0 top
R12650  10K  [0201]  102.16,31.14 0 top
R12651  10K  [0201]  102.16,31.75 0 top
R12652  10K  [0201]  102.16,32.36 0 top
R12653  10K  [0201]  102.16,32.97 0 top
R12654  10K  [0201]  102.16,33.58 0 top
R12655  10K  [0201]  102.16,34.19 0 top
R12656  10K  [0201]  102.16,34.8 0 top
R12657  10K  [0201]  102.16,35.41 0 top
R12658  10K  [0201]  102.16,36.02 0 top
R12659  10K  [0201]  102.16,36.63 0 top
R12660  10K  [0201]  102.16,37.24 0 top
R12661  10K  [0201]  102.16,37.85 0 top
R12662  10K  [0201]  102.16,38.46 0 top
R12663  10K  [0201]  102.16,39.07 0 top
R12664  10K  [0201]  102.16,39.67 0 top
R12665  10K  [0201]  102.16,40.28 0 top
R12666  10K  [0201]  102.16,40.89 0 top
R12667  10K  [0201]  102.16,41.5 0 top
R12668  10K  [0201]  102.16,42.11 0 top
R12669  10K  [0201]  102.16,42.72 0 top
R12670  10K  [0201]  102.16,43.33 0 top
R12671  10K  [0201]  102.16,43.94 0 top
R12672  10K  [0201]  102.16,44.55 0 top
R12673  10K  [0201]  102.16,45.16 0 top
R12674  10K  [0201]  102.16,45.77 0 top
R12675  10K  [0201]  102.16,46.38 0 top
R12676  10K  [0201]  102.16,46.99 0 top
R12677  10K  [0201]  102.16,47.6 0 top
R12678  10K  [0201]  102.16,48.21 0 top
R12679  10K  [0201]  102.16,48.82 0 top
R12680  10K  [0201]  102.16,49.43 0 top
R12681  10K  [0201]  102.16,50.04 0 top
R12682  10K  [0201]  102.16,50.65 0 top
R12683  10K  [0201]  102.16,51.26 0 top
R12684  10K  [0201]  102.16,51.87 0 top
R12685  10K  [0201]  102.16,52.48 0 top
R12686  10K  [0201]  102.16,53.09 0 top
R12687  10K  [0201]  102.16,53.7 0 top
R12688  10K  [0201]  102.16,54.31 0 top
R12689  10K  [0201]  102.16,54.91 0 top
R12690  10K  [0201]  102.16,55.52 0 top
R12691  10K  [0201]  102.16,56.13 0 top
R12692  10K  [0201]  102.16,56.74 0 top
R12693  10K  [0201]  102.16,57.35 0 top
R12694  10K  [0201]  102.16,57.96 0 top
R12695  10K  [0201]  102.16,58.57 0 top
R12696  10K  [0201]  102.16,59.18 0 top
R12697  10K  [0201]  102.16,59.79 0 top
R12698  10K  [0201]  102.16,60.4 0 top
R12699  10K  [0201]  102.16,61.01 0 top
R12700  10K  [0201]  102.16,61.62 0 top
R12701  10K  [0201]  102.16,62.23 0 top
R12702  10K  [0201]  102.16,62.84 0 top
R12703  10K  [0201]  102.16,63.45 0 top
R12704  10K  [0201]  102.16,64.06 0 top
R12705  10K  [0201]  102.16,64.67 0 top
R12706  10K  [0201]  102.16,65.28 0 top
R12707  10K  [0201]  102.16,65.89 0 top
R12708  10K  [0201]  102.16,66.5 0 top
R12709  10K  [0201]  102.16,67.11 0 top
R12710  10K  [0201]  102.16,67.72 0 top
R12711  10K  [0201]  102.16,68.33 0 top
R12712  10K  [0201]  102.16,68.94 0 top
R12713  10K  [0201]  102.16,69.55 0 top
R12714  10K  [0201]  102.16,70.15 0 top
R12715  10K  [0201]  102.16,70.76 0 top
R12716  10K  [0201]  102.16,71.37 0 top
R12717  10K  [0201]  102.16,71.98 0 top
R12718  10K  [0201]  102.16,72.59 0 top
R12719  10K  [0201]  102.16,73.2 0 top
R12720  10K  [0201]  102.16,73.81 0 top
R12721  10K  [0201]  102.16,74.42 0 top
R12722  10K  [0201]  102.16,75.03 0 top
R12723  10K  [0201]  102.16,75.64 0 top
R12724  10K  [0201]  102.16,76.25 0 top
R12725  10K  [0201]  102.16,76.86 0 top
R12726  10K  [0201]  102.16,77.47 0 top
R12727  10K  [0201]  102.16,78.08 0 top
R12728  10K  [0201]  102.16,78.69 0 top
R12729  10K  [0201]  102.16,79.3 0 top
R12730  10K  [0201]  102.16,79.91 0 top
R12731  10K  [0201]  102.16,80.52 0 top
R12732  10K  [0201]  102.16,81.13 0 top
R12733  10K  [0201]  102.16,81.74 0 top
R12734  10K  [0201]  102.16,82.35 0 top
R12735  10K  [0201]  102.16,82.96 0 top
R12736  10K  [0201]  102.16,83.57 0 top
R12737  10K  [0201]  102.16,84.18 0 top
R12738  10K  [0201]  102.16,84.79 0 top
R12739  10K  [0201]  102.16,85.39 0 top
R12740  10K  [0201]  102.16,86 0 top
R12741  10K  [0201]  102.16,86.61 0 top
R12742  10K  [0201]  102.16,87.22 0 top
R12743  10K  [0201]  102.16,87.83 0 top
R12744  10K  [0201]  102.16,88.44 0 top
R12745  10K  [0201]  102.16,89.05 0 top
R12746  10K  [0201]  102.16,89.66 0 top
R12747  10K  [0201]  102.16,90.27 0 top
R12748  10K  [0201]  102.16,90.88 0 top
R12749  10K  [0201]  102.16,91.49 0 top
R12750  10K  [0201]  102.16,92.1 0 top
R12751  10K  [0201]  102.16,92.71 0 top
R12752  10K  [0201]  102.16,93.32 0 top
R12753  10K  [0201]  102.16,93.93 0 top
R12754  10K  [0201]  102.16,94.54 0 top
R12755  10K  [0201]  102.16,95.15 0 top
R12756  10K  [0201]  102.16,95.76 0 top
R12757  10K  [0201]  102.16,96.37 0 top
R12758  10K  [0201]  102.16,96.98 0 top
R12759  10K  [0201]  102.16,97.59 0 top
R12760  10K  [0201]  102.16,98.2 0 top
R12761  10K  [0201]  102.16,98.81 0 top
R12762  10K  [0201]  102.16,99.42 0 top
R12763  10K  [0201]  102.16,100.03 0 top
R12764  10K  [0201]  102.16,100.63 0 top
R12765  10K  [0201]  102.16,101.24 0 top
R12766  10K  [0201]  102.16,101.85 0 top
R12767  10K  [0201]  102.16,102.46 0 top
R12768  10K  [0201]  102.16,103.07 0 top
R12769  10K  [0201]  102.16,103.68 0 top
R12770  10K  [0201]  102.16,104.29 0 top
R12771  10K  [0201]  102.16,104.9 0 top
R12772  10K  [0201]  102.16,105.51 0 top
R12773  10K  [0201]  102.16,106.12 0 top
R12774  10K  [0201]  102.16,106.73 0 top
R12775  10K  [0201]  102.16,107.34 0 top
R12776  10K  [0201]  102.16,107.95 0 top
R12777  10K  [0201]  102.16,108.56 0 top
R12778  10K  [0201]  102.16,109.17 0 top
R12779  10K  [0201]  102.16,109.78 0 top
R12780  10K  [0201]  102.16,110.39 0 top
R12781  10K  [0201]  102.16,111 0 top
R12782  10K  [0201]  102.16,111.61 0 top
R12783  10K  [0201]  102.16,112.22 0 top
R12784  10K  [0201]  102.16,112.83 0 top
R12785  10K  [0201]  102.16,113.44 0 top
R12786  10K  [0201]  102.16,114.05 0 top
R12787  10K  [0201]  102.16,114.66 0 top
R12788  10K  [0201]  102.16,115.27 0 top
R12789  10K  [0201]  102.16,115.87 0 top
R12790  10K  [0201]  102.16,116.48 0 top
R12791  10K  [0201]  102.16,117.09 0 top
R12792  10K  [0201]  102.16,117.7 0 top
R12793  10K  [0201]  102.16,118.31 0 top
R12794  10K  [0201]  102.16,118.92 0 top
R12795  10K  [0201]  102.16,119.53 0 top
R12796  10K  [0201]  102.16,120.14 0 top
R12797  10K  [0201]  102.16,120.75 0 top
R12798  10K  [0201]  102.16,121.36 0 top
R12799  10K  [0201]  102.16,121.97 0 top
R12800  10K  [0201]  102.16,122.58 0 top
R12801  10K  [0201]  103.38,1.27 0 top
R12802  10K  [0201]  103.38,1.88 0 top
R12803  10K  [0201]  103.38,2.49 0 top
R12804  10K  [0201]  103.38,3.1 0 top
R12805  10K  [0201]  103.38,3.71 0 top
R12806  10K  [0201]  103.38,4.32 0 top
R12807  10K  [0201]  103.38,4.93 0 top
R12808  10K  [0201]  103.38,5.54 0 top
R12809  10K  [0201]  103.38,6.15 0 top
R12810  10K  [0201]  103.38,6.76 0 top
R12811  10K  [0201]  103.38,7.37 0 top
R12812  10K  [0201]  103.38,7.98 0 top
R12813  10K  [0201]  103.38,8.59 0 top
R12814  10K  [0201]  103.38,9.19 0 top
R12815  10K  [0201]  103.38,9.8 0 top
R12816  10K  [0201]  103.38,10.41 0 top
R12817  10K  [0201]  103.38,11.02 0 top
R12818  10K  [0201]  103.38,11.63 0 top
R12819  10K  [0201]  103.38,12.24 0 top
R12820  10K  [0201]  103.38,12.85 0 top
R12821  10K  [0201]  103.38,13.46 0 top
R12822  10K  [0201]  103.38,14.07 0 top
R12823  10K  [0201]  103.38,14.68 0 top
R12824  10K  [0201]  103.38,15.29 0 top
R12825  10K  [0201]  103.38,15.9 0 top
R12826  10K  [0201]  103.38,16.51 0 top
R12827  10K  [0201]  103.38,17.12 0 top
R12828  10K  [0201]  103.38,17.73 0 top
R12829  10K  [0201]  103.38,18.34 0 top
R12830  10K  [0201]  103.38,18.95 0 top
R12831  10K  [0201]  103.38,19.56 0 top
R12832  10K  [0201]  103.38,20.17 0 top
R12833  10K  [0201]  103.38,20.78 0 top
R12834  10K  [0201]  103.38,21.39 0 top
R12835  10K  [0201]  103.38,22 0 top
R12836  10K  [0201]  103.38,22.61 0 top
R12837  10K  [0201]  103.38,23.22 0 top
R12838  10K  [0201]  103.38,23.83 0 top
R12839  10K  [0201]  103.38,24.43 0 top
R12840  10K  [0201]  103.38,25.04 0 top
R12841  10K  [0201]  103.38,25.65 0 top
R12842  10K  [0201]  103.38,26.26 0 top
R12843  10K  [0201]  103.38,26.87 0 top
R12844  10K  [0201]  103.38,27.48 0 top
R12845  10K  [0201]  103.38,28.09 0 top
R12846  10K  [0201]  103.38,28.7 0 top
R12847  10K  [0201]  103.38,29.31 0 top
R12848  10K  [0201]  103.38,29.92 0 top
R12849  10K  [0201]  103.38,30.53 0 top
R12850  10K  [0201]  103.38,31.14 0 top
R12851  10K  [0201]  103.38,31.75 0 top
R12852  10K  [0201]  103.38,32.36 0 top
R12853  10K  [0201]  103.38,32.97 0 top
R12854  10K  [0201]  103.38,33.58 0 top
R12855  10K  [0201]  103.38,34.19 0 top
R12856  10K  [0201]  103.38,34.8 0 top
R12857  10K  [0201]  103.38,35.41 0 top
R12858  10K  [0201]  103.38,36.02 0 top
R12859  10K  [0201]  103.38,36.63 0 top
R12860  10K  [0201]  103.38,37.24 0 top
R12861  10K  [0201]  103.38,37.85 0 top
R12862  10K  [0201]  103.38,38.46 0 top
R12863  10K  [0201]  103.38,39.07 0 top
R12864  10K  [0201]  103.38,39.67 0 top
R12865  10K  [0201]  103.38,40.28 0 top
R12866  10K  [0201]  103.38,40.89 0 top
R12867  10K  [0201]  103.38,41.5 0 top
R12868  10K  [0201]  103.38,42.11 0 top
R12869  10K  [0201]  103.38,42.72 0 top
R12870  10K  [0201]  103.38,43.33 0 top
R12871  10K  [0201]  103.38,43.94 0 top
R12872  10K  [0201]  103.38,44.55 0 top
R12873  10K  [0201]  103.38,45.16 0 top
R12874  10K  [0201]  103.38,45.77 0 top
R12875  10K  [0201]  103.38,46.38 0 top
R12876  10K  [0201]  103.38,46.99 0 top
R12877  10K  [0201]  103.38,47.6 0 top
R12878  10K  [0201]  103.38,48.21 0 top
R12879  10K  [0201]  103.38,48.82 0 top
R12880  10K  [0201]  103.38,49.43 0 top
R12881  10K  [0201]  103.38,50.04 0 top
R12882  10K  [0201]  103.38,50.65 0 top
R12883  10K  [0201]  103.38,51.26 0 top
R12884  10K  [0201]  103.38,51.87 0 top
R12885  10K  [0201]  103.38,52.48 0 top
R12886  10K  [0201]  103.38,53.09 0 top
R12887  10K  [0201]  103.38,53.7 0 top
R12888  10K  [0201]  103.38,54.31 0 top
R12889  10K  [0201]  103.38,54.91 0 top
R12890  10K  [0201]  103.38,55.52 0 top
R12891  10K  [0201]  103.38,56.13 0 top
R12892  10K  [0201]  103.38,56.74 0 top
R12893  10K  [0201]  103.38,57.35 0 top
R12894  10K  [0201]  103.38,57.96 0 top
R12895  10K  [0201]  103.38,58.57 0 top
R12896  10K  [0201]  103.38,59.18 0 top
R12897  10K  [0201]  103.38,59.79 0 top
R12898  10K  [0201]  103.38,60.4 0 top
R12899  10K  [0201]  103.38,61.01 0 top
R12900  10K  [0201]  103.38,61.62 0 top
R12901  10K  [0201]  103.38,62.23 0 top
R12902  10K  [0201]  103.38,62.84 0 top
R12903  10K  [0201]  103.38,63.45 0 top
R12904  10K  [0201]  103.38,64.06 0 top
R12905  10K  [0201]  103.38,64.67 0 top
R12906  10K  [0201]  103.38,65.28 0 top
R12907  10K  [0201]  103.38,65.89 0 top
R12908  10K  [0201]  103.38,66.5 0 top
R12909  10K  [0201]  103.38,67.11 0 top
R12910  10K  [0201]  103.38,67.72 0 top
R12911  10K  [0201]  103.38,68.33 0 top
R12912  10K  [0201]  103.38,68.94 0 top
R12913  10K  [0201]  103.38,69.55 0 top
R12914  10K  [0201]  103.38,70.15 0 top
R12915  10K  [0201]  103.38,70.76 0 top
R12916  10K  [0201]  103.38,71.37 0 top
R12917  10K  [0201]  103.38,71.98 0 top
R12918  10K  [0201]  103.38,72.59 0 top
R12919  10K  [0201]  103.38,73.2 0 top
R12920  10K  [0201]  103.38,73.81 0 top
R12921  10K  [0201]  103.38,74.42 0 top
R12922  10K  [0201]  103.38,75.03 0 top
R12923  10K  [0201]  103.38,75.64 0 top
R12924  10K  [0201]  103.38,76.25 0 top
R12925  10K  [0201]  103.38,76.86 0 top
R12926  10K  [0201]  103.38,77.47 0 top
R12927  10K  [0201]  103.38,78.08 0 top
R12928  10K  [0201]  103.38,78.69 0 top
R12929  10K  [0201]  103.38,79.3 0 top
R12930  10K  [0201]  103.38,79.91 0 top
R12931  10K  [0201]  103.38,80.52 0 top
R12932  10K  [0201]  103.38,81.13 0 top
R12933  10K  [0201]  103.38,81.74 0 top
R12934  10K  [0201]  103.38,82.35 0 top
R12935  10K  [0201]  103.38,82.96 0 top
R12936  10K  [0201]  103.38,83.57 0 top
R12937  10K  [0201]  103.38,84.18 0 top
R12938  10K  [0201]  103.38,84.79 0 top
R12939  10K  [0201]  103.38,85.39 0 top
R12940  10K  [0201]  103.38,86 0 top
R12941  10K  [0201]  103.38,86.61 0 top
R12942  10K  [0201]  103.38,87.22 0 top
R12943  10K  [0201]  103.38,87.83 0 top
R12944  10K  [0201]  103.38,88.44 0 top
R12945  10K  [0201]  103.38,89.05 0 top
R12946  10K  [0201]  103.38,89.66 0 top
R12947  10K  [0201]  103.38,90.27 0 top
R12948  10K  [0201]  103.38,90.88 0 top
R12949  10K  [0201]  103.38,91.49 0 top
R12950  10K  [0201]  103.38,92.1 0 top
R12951  10K  [0201]  103.38,92.71 0 top
R12952  10K  [0201]  103.38,93.32 0 top
R12953  10K  [0201]  103.38,93.93 0 top
R12954  10K  [0201]  103.38,94.54 0 top
R12955  10K  [0201]  103.38,95.15 0 top
R12956  10K  [0201]  103.38,95.76 0 top
R12957  10K  [0201]  103.38,96.37 0 top
R12958  10K  [0201]  103.38,96.98 0 top
R12959  10K  [0201]  103.38,97.59 0 top
R12960  10K  [0201]  103.38,98.2 0 top
R12961  10K  [0201]  103.38,98.81 0 top
R12962  10K  [0201]  103.38,99.42 0 top
R12963  10K  [0201]  103.38,100.03 0 top
R12964  10K  [0201]  103.38,100.63 0 top
R12965  10K  [0201]  103.38,101.24 0 top
R12966  10K  [0201]  103.38,101.85 0 top
R12967  10K  [0201]  103.38,102.46 0 top
R12968  10K  [0201]  103.38,103.07 0 top
R12969  10K  [0201]  103.38,103.68 0 top
R12970  10K  [0201]  103.38,104.29 0 top
R12971  10K  [0201]  103.38,104.9 0 top
R12972  10K  [0201]  103.38,105.51 0 top
R12973  10K  [0201]  103.38,106.12 0 top
R12974  10K  [0201]  103.38,106.73 0 top
R12975  10K  [0201]  103.38,107.34 0 top
R12976  10K  [0201]  103.38,107.95 0 top
R12977  10K  [0201]  103.38,108.56 0 top
R12978  10K  [0201]  103.38,109.17 0 top
R12979  10K  [0201]  103.38,109.78 0 top
R12980  10K  [0201]  103.38,110.39 0 top
R12981  10K  [0201]  103.38,111 0 top
R12982  10K  [0201]  103.38,111.61 0 top
R12983  10K  [0201]  103.38,112.22 0 top
R12984  10K  [0201]  103.38,112.83 0 top
R12985  10K  [0201]  103.38,113.44 0 top
R12986  10K  [0201]  103.38,114.05 0 top
R12987  10K  [0201]  103.38,114.66 0 top
R12988  10K  [0201]  103.38,115.27 0 top
R12989  10K  [0201]  103.38,115.87 0 top
R12990  10K  [0201]  103.38,116.48 0 top
R12991  10K  [0201]  103.38,117.09 0 top
R12992  10K  [0201]  103.38,117.7 0 top
R12993  10K  [0201]  103.38,118.31 0 top
R12994  10K  [0201]  103.38,118.92 0 top
R12995  10K  [0201]  103.38,119.53 0 top
R12996  10K  [0201]  103.38,120.14 0 top
R12997  10K  [0201]  103.38,120.75 0 top
R12998  10K  [0201]  103.38,121.36 0 top
R12999  10K  [0201]  103.38,121.97 0 top
R13000  10K  [0201]  103.38,122.58 0 top
R13001  10K  [0201]  104.6,1.27 0 top
R13002  10K  [0201]  104.6,1.88 0 top
R13003  10K  [0201]  104.6,2.49 0 top
R13004  10K  [0201]  104.6,3.1 0 top
R13005  10K  [0201]  104.6,3.71 0 top
R13006  10K  [0201]  104.6,4.32 0 top
R13007  10K  [0201]  104.6,4.93 0 top
R13008  10K  [0201]  104.6,5.54 0 top
R13009  10K  [0201]  104.6,6.15 0 top